# EAGLE board Resistor_Resistor (EAGLE 8.3.0), part 9 of 32
## Placement (x,y rotation side) (continued)
R10473  10K  [0201]  88.75,45.16 0 top
R10474  10K  [0201]  88.75,45.77 0 top
R10475  10K  [0201]  88.75,46.38 0 top
R10476  10K  [0201]  88.75,46.99 0 top
R10477  10K  [0201]  88.75,47.6 0 top
R10478  10K  [0201]  88.75,48.21 0 top
R10479  10K  [0201]  88.75,48.82 0 top
R10480  10K  [0201]  88.75,49.43 0 top
R10481  10K  [0201]  88.75,50.04 0 top
R10482  10K  [0201]  88.75,50.65 0 top
R10483  10K  [0201]  88.75,51.26 0 top
R10484  10K  [0201]  88.75,51.87 0 top
R10485  10K  [0201]  88.75,52.48 0 top
R10486  10K  [0201]  88.75,53.09 0 top
R10487  10K  [0201]  88.75,53.7 0 top
R10488  10K  [0201]  88.75,54.31 0 top
R10489  10K  [0201]  88.75,54.91 0 top
R10490  10K  [0201]  88.75,55.52 0 top
R10491  10K  [0201]  88.75,56.13 0 top
R10492  10K  [0201]  88.75,56.74 0 top
R10493  10K  [0201]  88.75,57.35 0 top
R10494  10K  [0201]  88.75,57.96 0 top
R10495  10K  [0201]  88.75,58.57 0 top
R10496  10K  [0201]  88.75,59.18 0 top
R10497  10K  [0201]  88.75,59.79 0 top
R10498  10K  [0201]  88.75,60.4 0 top
R10499  10K  [0201]  88.75,61.01 0 top
R10500  10K  [0201]  88.75,61.62 0 top
R10501  10K  [0201]  88.75,62.23 0 top
R10502  10K  [0201]  88.75,62.84 0 top
R10503  10K  [0201]  88.75,63.45 0 top
R10504  10K  [0201]  88.75,64.06 0 top
R10505  10K  [0201]  88.75,64.67 0 top
R10506  10K  [0201]  88.75,65.28 0 top
R10507  10K  [0201]  88.75,65.89 0 top
R10508  10K  [0201]  88.75,66.5 0 top
R10509  10K  [0201]  88.75,67.11 0 top
R10510  10K  [0201]  88.75,67.72 0 top
R10511  10K  [0201]  88.75,68.33 0 top
R10512  10K  [0201]  88.75,68.94 0 top
R10513  10K  [0201]  88.75,69.55 0 top
R10514  10K  [0201]  88.75,70.15 0 top
R10515  10K  [0201]  88.75,70.76 0 top
R10516  10K  [0201]  88.75,71.37 0 top
R10517  10K  [0201]  88.75,71.98 0 top
R10518  10K  [0201]  88.75,72.59 0 top
R10519  10K  [0201]  88.75,73.2 0 top
R10520  10K  [0201]  88.75,73.81 0 top
R10521  10K  [0201]  88.75,74.42 0 top
R10522  10K  [0201]  88.75,75.03 0 top
R10523  10K  [0201]  88.75,75.64 0 top
R10524  10K  [0201]  88.75,76.25 0 top
R10525  10K  [0201]  88.75,76.86 0 top
R10526  10K  [0201]  88.75,77.47 0 top
R10527  10K  [0201]  88.75,78.08 0 top
R10528  10K  [0201]  88.75,78.69 0 top
R10529  10K  [0201]  88.75,79.3 0 top
R10530  10K  [0201]  88.75,79.91 0 top
R10531  10K  [0201]  88.75,80.52 0 top
R10532  10K  [0201]  88.75,81.13 0 top
R10533  10K  [0201]  88.75,81.74 0 top
R10534  10K  [0201]  88.75,82.35 0 top
R10535  10K  [0201]  88.75,82.96 0 top
R10536  10K  [0201]  88.75,83.57 0 top
R10537  10K  [0201]  88.75,84.18 0 top
R10538  10K  [0201]  88.75,84.79 0 top
R10539  10K  [0201]  88.75,85.39 0 top
R10540  10K  [0201]  88.75,86 0 top
R10541  10K  [0201]  88.75,86.61 0 top
R10542  10K  [0201]  88.75,87.22 0 top
R10543  10K  [0201]  88.75,87.83 0 top
R10544  10K  [0201]  88.75,88.44 0 top
R10545  10K  [0201]  88.75,89.05 0 top
R10546  10K  [0201]  88.75,89.66 0 top
R10547  10K  [0201]  88.75,90.27 0 top
R10548  10K  [0201]  88.75,90.88 0 top
R10549  10K  [0201]  88.75,91.49 0 top
R10550  10K  [0201]  88.75,92.1 0 top
R10551  10K  [0201]  88.75,92.71 0 top
R10552  10K  [0201]  88.75,93.32 0 top
R10553  10K  [0201]  88.75,93.93 0 top
R10554  10K  [0201]  88.75,94.54 0 top
R10555  10K  [0201]  88.75,95.15 0 top
R10556  10K  [0201]  88.75,95.76 0 top
R10557  10K  [0201]  88.75,96.37 0 top
R10558  10K  [0201]  88.75,96.98 0 top
R10559  10K  [0201]  88.75,97.59 0 top
R10560  10K  [0201]  88.75,98.2 0 top
R10561  10K  [0201]  88.75,98.81 0 top
R10562  10K  [0201]  88.75,99.42 0 top
R10563  10K  [0201]  88.75,100.03 0 top
R10564  10K  [0201]  88.75,100.63 0 top
R10565  10K  [0201]  88.75,101.24 0 top
R10566  10K  [0201]  88.75,101.85 0 top
R10567  10K  [0201]  88.75,102.46 0 top
R10568  10K  [0201]  88.75,103.07 0 top
R10569  10K  [0201]  88.75,103.68 0 top
R10570  10K  [0201]  88.75,104.29 0 top
R10571  10K  [0201]  88.75,104.9 0 top
R10572  10K  [0201]  88.75,105.51 0 top
R10573  10K  [0201]  88.75,106.12 0 top
R10574  10K  [0201]  88.75,106.73 0 top
R10575  10K  [0201]  88.75,107.34 0 top
R10576  10K  [0201]  88.75,107.95 0 top
R10577  10K  [0201]  88.75,108.56 0 top
R10578  10K  [0201]  88.75,109.17 0 top
R10579  10K  [0201]  88.75,109.78 0 top
R10580  10K  [0201]  88.75,110.39 0 top
R10581  10K  [0201]  88.75,111 0 top
R10582  10K  [0201]  88.75,111.61 0 top
R10583  10K  [0201]  88.75,112.22 0 top
R10584  10K  [0201]  88.75,112.83 0 top
R10585  10K  [0201]  88.75,113.44 0 top
R10586  10K  [0201]  88.75,114.05 0 top
R10587  10K  [0201]  88.75,114.66 0 top
R10588  10K  [0201]  88.75,115.27 0 top
R10589  10K  [0201]  88.75,115.87 0 top
R10590  10K  [0201]  88.75,116.48 0 top
R10591  10K  [0201]  88.75,117.09 0 top
R10592  10K  [0201]  88.75,117.7 0 top
R10593  10K  [0201]  88.75,118.31 0 top
R10594  10K  [0201]  88.75,118.92 0 top
R10595  10K  [0201]  88.75,119.53 0 top
R10596  10K  [0201]  88.75,120.14 0 top
R10597  10K  [0201]  88.75,120.75 0 top
R10598  10K  [0201]  88.75,121.36 0 top
R10599  10K  [0201]  88.75,121.97 0 top
R10600  10K  [0201]  88.75,122.58 0 top
R10601  10K  [0201]  89.97,1.27 0 top
R10602  10K  [0201]  89.97,1.88 0 top
R10603  10K  [0201]  89.97,2.49 0 top
R10604  10K  [0201]  89.97,3.1 0 top
R10605  10K  [0201]  89.97,3.71 0 top
R10606  10K  [0201]  89.97,4.32 0 top
R10607  10K  [0201]  89.97,4.93 0 top
R10608  10K  [0201]  89.97,5.54 0 top
R10609  10K  [0201]  89.97,6.15 0 top
R10610  10K  [0201]  89.97,6.76 0 top
R10611  10K  [0201]  89.97,7.37 0 top
R10612  10K  [0201]  89.97,7.98 0 top
R10613  10K  [0201]  89.97,8.59 0 top
R10614  10K  [0201]  89.97,9.19 0 top
R10615  10K  [0201]  89.97,9.8 0 top
R10616  10K  [0201]  89.97,10.41 0 top
R10617  10K  [0201]  89.97,11.02 0 top
R10618  10K  [0201]  89.97,11.63 0 top
R10619  10K  [0201]  89.97,12.24 0 top
R10620  10K  [0201]  89.97,12.85 0 top
R10621  10K  [0201]  89.97,13.46 0 top
R10622  10K  [0201]  89.97,14.07 0 top
R10623  10K  [0201]  89.97,14.68 0 top
R10624  10K  [0201]  89.97,15.29 0 top
R10625  10K  [0201]  89.97,15.9 0 top
R10626  10K  [0201]  89.97,16.51 0 top
R10627  10K  [0201]  89.97,17.12 0 top
R10628  10K  [0201]  89.97,17.73 0 top
R10629  10K  [0201]  89.97,18.34 0 top
R10630  10K  [0201]  89.97,18.95 0 top
R10631  10K  [0201]  89.97,19.56 0 top
R10632  10K  [0201]  89.97,20.17 0 top
R10633  10K  [0201]  89.97,20.78 0 top
R10634  10K  [0201]  89.97,21.39 0 top
R10635  10K  [0201]  89.97,22 0 top
R10636  10K  [0201]  89.97,22.61 0 top
R10637  10K  [0201]  89.97,23.22 0 top
R10638  10K  [0201]  89.97,23.83 0 top
R10639  10K  [0201]  89.97,24.43 0 top
R10640  10K  [0201]  89.97,25.04 0 top
R10641  10K  [0201]  89.97,25.65 0 top
R10642  10K  [0201]  89.97,26.26 0 top
R10643  10K  [0201]  89.97,26.87 0 top
R10644  10K  [0201]  89.97,27.48 0 top
R10645  10K  [0201]  89.97,28.09 0 top
R10646  10K  [0201]  89.97,28.7 0 top
R10647  10K  [0201]  89.97,29.31 0 top
R10648  10K  [0201]  89.97,29.92 0 top
R10649  10K  [0201]  89.97,30.53 0 top
R10650  10K  [0201]  89.97,31.14 0 top
R10651  10K  [0201]  89.97,31.75 0 top
R10652  10K  [0201]  89.97,32.36 0 top
R10653  10K  [0201]  89.97,32.97 0 top
R10654  10K  [0201]  89.97,33.58 0 top
R10655  10K  [0201]  89.97,34.19 0 top
R10656  10K  [0201]  89.97,34.8 0 top
R10657  10K  [0201]  89.97,35.41 0 top
R10658  10K  [0201]  89.97,36.02 0 top
R10659  10K  [0201]  89.97,36.63 0 top
R10660  10K  [0201]  89.97,37.24 0 top
R10661  10K  [0201]  89.97,37.85 0 top
R10662  10K  [0201]  89.97,38.46 0 top
R10663  10K  [0201]  89.97,39.07 0 top
R10664  10K  [0201]  89.97,39.67 0 top
R10665  10K  [0201]  89.97,40.28 0 top
R10666  10K  [0201]  89.97,40.89 0 top
R10667  10K  [0201]  89.97,41.5 0 top
R10668  10K  [0201]  89.97,42.11 0 top
R10669  10K  [0201]  89.97,42.72 0 top
R10670  10K  [0201]  89.97,43.33 0 top
R10671  10K  [0201]  89.97,43.94 0 top
R10672  10K  [0201]  89.97,44.55 0 top
R10673  10K  [0201]  89.97,45.16 0 top
R10674  10K  [0201]  89.97,45.77 0 top
R10675  10K  [0201]  89.97,46.38 0 top
R10676  10K  [0201]  89.97,46.99 0 top
R10677  10K  [0201]  89.97,47.6 0 top
R10678  10K  [0201]  89.97,48.21 0 top
R10679  10K  [0201]  89.97,48.82 0 top
R10680  10K  [0201]  89.97,49.43 0 top
R10681  10K  [0201]  89.97,50.04 0 top
R10682  10K  [0201]  89.97,50.65 0 top
R10683  10K  [0201]  89.97,51.26 0 top
R10684  10K  [0201]  89.97,51.87 0 top
R10685  10K  [0201]  89.97,52.48 0 top
R10686  10K  [0201]  89.97,53.09 0 top
R10687  10K  [0201]  89.97,53.7 0 top
R10688  10K  [0201]  89.97,54.31 0 top
R10689  10K  [0201]  89.97,54.91 0 top
R10690  10K  [0201]  89.97,55.52 0 top
R10691  10K  [0201]  89.97,56.13 0 top
R10692  10K  [0201]  89.97,56.74 0 top
R10693  10K  [0201]  89.97,57.35 0 top
R10694  10K  [0201]  89.97,57.96 0 top
R10695  10K  [0201]  89.97,58.57 0 top
R10696  10K  [0201]  89.97,59.18 0 top
R10697  10K  [0201]  89.97,59.79 0 top
R10698  10K  [0201]  89.97,60.4 0 top
R10699  10K  [0201]  89.97,61.01 0 top
R10700  10K  [0201]  89.97,61.62 0 top
R10701  10K  [0201]  89.97,62.23 0 top
R10702  10K  [0201]  89.97,62.84 0 top
R10703  10K  [0201]  89.97,63.45 0 top
R10704  10K  [0201]  89.97,64.06 0 top
R10705  10K  [0201]  89.97,64.67 0 top
R10706  10K  [0201]  89.97,65.28 0 top
R10707  10K  [0201]  89.97,65.89 0 top
R10708  10K  [0201]  89.97,66.5 0 top
R10709  10K  [0201]  89.97,67.11 0 top
R10710  10K  [0201]  89.97,67.72 0 top
R10711  10K  [0201]  89.97,68.33 0 top
R10712  10K  [0201]  89.97,68.94 0 top
R10713  10K  [0201]  89.97,69.55 0 top
R10714  10K  [0201]  89.97,70.15 0 top
R10715  10K  [0201]  89.97,70.76 0 top
R10716  10K  [0201]  89.97,71.37 0 top
R10717  10K  [0201]  89.97,71.98 0 top
R10718  10K  [0201]  89.97,72.59 0 top
R10719  10K  [0201]  89.97,73.2 0 top
R10720  10K  [0201]  89.97,73.81 0 top
R10721  10K  [0201]  89.97,74.42 0 top
R10722  10K  [0201]  89.97,75.03 0 top
R10723  10K  [0201]  89.97,75.64 0 top
R10724  10K  [0201]  89.97,76.25 0 top
R10725  10K  [0201]  89.97,76.86 0 top
R10726  10K  [0201]  89.97,77.47 0 top
R10727  10K  [0201]  89.97,78.08 0 top
R10728  10K  [0201]  89.97,78.69 0 top
R10729  10K  [0201]  89.97,79.3 0 top
R10730  10K  [0201]  89.97,79.91 0 top
R10731  10K  [0201]  89.97,80.52 0 top
R10732  10K  [0201]  89.97,81.13 0 top
R10733  10K  [0201]  89.97,81.74 0 top
R10734  10K  [0201]  89.97,82.35 0 top
R10735  10K  [0201]  89.97,82.96 0 top
R10736  10K  [0201]  89.97,83.57 0 top
R10737  10K  [0201]  89.97,84.18 0 top
R10738  10K  [0201]  89.97,84.79 0 top
R10739  10K  [0201]  89.97,85.39 0 top
R10740  10K  [0201]  89.97,86 0 top
R10741  10K  [0201]  89.97,86.61 0 top
R10742  10K  [0201]  89.97,87.22 0 top
R10743  10K  [0201]  89.97,87.83 0 top
R10744  10K  [0201]  89.97,88.44 0 top
R10745  10K  [0201]  89.97,89.05 0 top
R10746  10K  [0201]  89.97,89.66 0 top
R10747  10K  [0201]  89.97,90.27 0 top
R10748  10K  [0201]  89.97,90.88 0 top
R10749  10K  [0201]  89.97,91.49 0 top
R10750  10K  [0201]  89.97,92.1 0 top
R10751  10K  [0201]  89.97,92.71 0 top
R10752  10K  [0201]  89.97,93.32 0 top
R10753  10K  [0201]  89.97,93.93 0 top
R10754  10K  [0201]  89.97,94.54 0 top
R10755  10K  [0201]  89.97,95.15 0 top
R10756  10K  [0201]  89.97,95.76 0 top
R10757  10K  [0201]  89.97,96.37 0 top
R10758  10K  [0201]  89.97,96.98 0 top
R10759  10K  [0201]  89.97,97.59 0 top
R10760  10K  [0201]  89.97,98.2 0 top
R10761  10K  [0201]  89.97,98.81 0 top
R10762  10K  [0201]  89.97,99.42 0 top
R10763  10K  [0201]  89.97,100.03 0 top
R10764  10K  [0201]  89.97,100.63 0 top
R10765  10K  [0201]  89.97,101.24 0 top
R10766  10K  [0201]  89.97,101.85 0 top
R10767  10K  [0201]  89.97,102.46 0 top
R10768  10K  [0201]  89.97,103.07 0 top
R10769  10K  [0201]  89.97,103.68 0 top
R10770  10K  [0201]  89.97,104.29 0 top
R10771  10K  [0201]  89.97,104.9 0 top
R10772  10K  [0201]  89.97,105.51 0 top
R10773  10K  [0201]  89.97,106.12 0 top
R10774  10K  [0201]  89.97,106.73 0 top
R10775  10K  [0201]  89.97,107.34 0 top
R10776  10K  [0201]  89.97,107.95 0 top
R10777  10K  [0201]  89.97,108.56 0 top
R10778  10K  [0201]  89.97,109.17 0 top
R10779  10K  [0201]  89.97,109.78 0 top
R10780  10K  [0201]  89.97,110.39 0 top
R10781  10K  [0201]  89.97,111 0 top
R10782  10K  [0201]  89.97,111.61 0 top
R10783  10K  [0201]  89.97,112.22 0 top
R10784  10K  [0201]  89.97,112.83 0 top
R10785  10K  [0201]  89.97,113.44 0 top
R10786  10K  [0201]  89.97,114.05 0 top
R10787  10K  [0201]  89.97,114.66 0 top
R10788  10K  [0201]  89.97,115.27 0 top
R10789  10K  [0201]  89.97,115.87 0 top
R10790  10K  [0201]  89.97,116.48 0 top
R10791  10K  [0201]  89.97,117.09 0 top
R10792  10K  [0201]  89.97,117.7 0 top
R10793  10K  [0201]  89.97,118.31 0 top
R10794  10K  [0201]  89.97,118.92 0 top
R10795  10K  [0201]  89.97,119.53 0 top
R10796  10K  [0201]  89.97,120.14 0 top
R10797  10K  [0201]  89.97,120.75 0 top
R10798  10K  [0201]  89.97,121.36 0 top
R10799  10K  [0201]  89.97,121.97 0 top
R10800  10K  [0201]  89.97,122.58 0 top
R10801  10K  [0201]  91.19,1.27 0 top
R10802  10K  [0201]  91.19,1.88 0 top
R10803  10K  [0201]  91.19,2.49 0 top
R10804  10K  [0201]  91.19,3.1 0 top
R10805  10K  [0201]  91.19,3.71 0 top
R10806  10K  [0201]  91.19,4.32 0 top
R10807  10K  [0201]  91.19,4.93 0 top
R10808  10K  [0201]  91.19,5.54 0 top
R10809  10K  [0201]  91.19,6.15 0 top
R10810  10K  [0201]  91.19,6.76 0 top
R10811  10K  [0201]  91.19,7.37 0 top
R10812  10K  [0201]  91.19,7.98 0 top
R10813  10K  [0201]  91.19,8.59 0 top
R10814  10K  [0201]  91.19,9.19 0 top
R10815  10K  [0201]  91.19,9.8 0 top
R10816  10K  [0201]  91.19,10.41 0 top
R10817  10K  [0201]  91.19,11.02 0 top
R10818  10K  [0201]  91.19,11.63 0 top
R10819  10K  [0201]  91.19,12.24 0 top
R10820  10K  [0201]  91.19,12.85 0 top
R10821  10K  [0201]  91.19,13.46 0 top
R10822  10K  [0201]  91.19,14.07 0 top
R10823  10K  [0201]  91.19,14.68 0 top
R10824  10K  [0201]  91.19,15.29 0 top
R10825  10K  [0201]  91.19,15.9 0 top
R10826  10K  [0201]  91.19,16.51 0 top
R10827  10K  [0201]  91.19,17.12 0 top
R10828  10K  [0201]  91.19,17.73 0 top
R10829  10K  [0201]  91.19,18.34 0 top
R10830  10K  [0201]  91.19,18.95 0 top
R10831  10K  [0201]  91.19,19.56 0 top
R10832  10K  [0201]  91.19,20.17 0 top
R10833  10K  [0201]  91.19,20.78 0 top
R10834  10K  [0201]  91.19,21.39 0 top
R10835  10K  [0201]  91.19,22 0 top
R10836  10K  [0201]  91.19,22.61 0 top
R10837  10K  [0201]  91.19,23.22 0 top
R10838  10K  [0201]  91.19,23.83 0 top
R10839  10K  [0201]  91.19,24.43 0 top
R10840  10K  [0201]  91.19,25.04 0 top
R10841  10K  [0201]  91.19,25.65 0 top
R10842  10K  [0201]  91.19,26.26 0 top
R10843  10K  [0201]  91.19,26.87 0 top
R10844  10K  [0201]  91.19,27.48 0 top
R10845  10K  [0201]  91.19,28.09 0 top
R10846  10K  [0201]  91.19,28.7 0 top
R10847  10K  [0201]  91.19,29.31 0 top
R10848  10K  [0201]  91.19,29.92 0 top
R10849  10K  [0201]  91.19,30.53 0 top
R10850  10K  [0201]  91.19,31.14 0 top
R10851  10K  [0201]  91.19,31.75 0 top
R10852  10K  [0201]  91.19,32.36 0 top
R10853  10K  [0201]  91.19,32.97 0 top
R10854  10K  [0201]  91.19,33.58 0 top
R10855  10K  [0201]  91.19,34.19 0 top
R10856  10K  [0201]  91.19,34.8 0 top
R10857  10K  [0201]  91.19,35.41 0 top
R10858  10K  [0201]  91.19,36.02 0 top
R10859  10K  [0201]  91.19,36.63 0 top
R10860  10K  [0201]  91.19,37.24 0 top
R10861  10K  [0201]  91.19,37.85 0 top
R10862  10K  [0201]  91.19,38.46 0 top
R10863  10K  [0201]  91.19,39.07 0 top
R10864  10K  [0201]  91.19,39.67 0 top
R10865  10K  [0201]  91.19,40.28 0 top
R10866  10K  [0201]  91.19,40.89 0 top
R10867  10K  [0201]  91.19,41.5 0 top
R10868  10K  [0201]  91.19,42.11 0 top
R10869  10K  [0201]  91.19,42.72 0 top
R10870  10K  [0201]  91.19,43.33 0 top
R10871  10K  [0201]  91.19,43.94 0 top
R10872  10K  [0201]  91.19,44.55 0 top
R10873  10K  [0201]  91.19,45.16 0 top
R10874  10K  [0201]  91.19,45.77 0 top
R10875  10K  [0201]  91.19,46.38 0 top
R10876  10K  [0201]  91.19,46.99 0 top
R10877  10K  [0201]  91.19,47.6 0 top
R10878  10K  [0201]  91.19,48.21 0 top
R10879  10K  [0201]  91.19,48.82 0 top
R10880  10K  [0201]  91.19,49.43 0 top
R10881  10K  [0201]  91.19,50.04 0 top
R10882  10K  [0201]  91.19,50.65 0 top
R10883  10K  [0201]  91.19,51.26 0 top
R10884  10K  [0201]  91.19,51.87 0 top
R10885  10K  [0201]  91.19,52.48 0 top
R10886  10K  [0201]  91.19,53.09 0 top
R10887  10K  [0201]  91.19,53.7 0 top
R10888  10K  [0201]  91.19,54.31 0 top
R10889  10K  [0201]  91.19,54.91 0 top
R10890  10K  [0201]  91.19,55.52 0 top
R10891  10K  [0201]  91.19,56.13 0 top
R10892  10K  [0201]  91.19,56.74 0 top
R10893  10K  [0201]  91.19,57.35 0 top
R10894  10K  [0201]  91.19,57.96 0 top
R10895  10K  [0201]  91.19,58.57 0 top
R10896  10K  [0201]  91.19,59.18 0 top
R10897  10K  [0201]  91.19,59.79 0 top
R10898  10K  [0201]  91.19,60.4 0 top
R10899  10K  [0201]  91.19,61.01 0 top
R10900  10K  [0201]  91.19,61.62 0 top
R10901  10K  [0201]  91.19,62.23 0 top
R10902  10K  [0201]  91.19,62.84 0 top
R10903  10K  [0201]  91.19,63.45 0 top
R10904  10K  [0201]  91.19,64.06 0 top
R10905  10K  [0201]  91.19,64.67 0 top
R10906  10K  [0201]  91.19,65.28 0 top
R10907  10K  [0201]  91.19,65.89 0 top
R10908  10K  [0201]  91.19,66.5 0 top
R10909  10K  [0201]  91.19,67.11 0 top
R10910  10K  [0201]  91.19,67.72 0 top
R10911  10K  [0201]  91.19,68.33 0 top
R10912  10K  [0201]  91.19,68.94 0 top
R10913  10K  [0201]  91.19,69.55 0 top
R10914  10K  [0201]  91.19,70.15 0 top
R10915  10K  [0201]  91.19,70.76 0 top
R10916  10K  [0201]  91.19,71.37 0 top
R10917  10K  [0201]  91.19,71.98 0 top
R10918  10K  [0201]  91.19,72.59 0 top
R10919  10K  [0201]  91.19,73.2 0 top
R10920  10K  [0201]  91.19,73.81 0 top
R10921  10K  [0201]  91.19,74.42 0 top
R10922  10K  [0201]  91.19,75.03 0 top
R10923  10K  [0201]  91.19,75.64 0 top
R10924  10K  [0201]  91.19,76.25 0 top
R10925  10K  [0201]  91.19,76.86 0 top
R10926  10K  [0201]  91.19,77.47 0 top
R10927  10K  [0201]  91.19,78.08 0 top
R10928  10K  [0201]  91.19,78.69 0 top
R10929  10K  [0201]  91.19,79.3 0 top
R10930  10K  [0201]  91.19,79.91 0 top
R10931  10K  [0201]  91.19,80.52 0 top
R10932  10K  [0201]  91.19,81.13 0 top
R10933  10K  [0201]  91.19,81.74 0 top
R10934  10K  [0201]  91.19,82.35 0 top
R10935  10K  [0201]  91.19,82.96 0 top
R10936  10K  [0201]  91.19,83.57 0 top
R10937  10K  [0201]  91.19,84.18 0 top
R10938  10K  [0201]  91.19,84.79 0 top
R10939  10K  [0201]  91.19,85.39 0 top
R10940  10K  [0201]  91.19,86 0 top
R10941  10K  [0201]  91.19,86.61 0 top
R10942  10K  [0201]  91.19,87.22 0 top
R10943  10K  [0201]  91.19,87.83 0 top
R10944  10K  [0201]  91.19,88.44 0 top
R10945  10K  [0201]  91.19,89.05 0 top
R10946  10K  [0201]  91.19,89.66 0 top
R10947  10K  [0201]  91.19,90.27 0 top
R10948  10K  [0201]  91.19,90.88 0 top
R10949  10K  [0201]  91.19,91.49 0 top
R10950  10K  [0201]  91.19,92.1 0 top
R10951  10K  [0201]  91.19,92.71 0 top
R10952  10K  [0201]  91.19,93.32 0 top
R10953  10K  [0201]  91.19,93.93 0 top
R10954  10K  [0201]  91.19,94.54 0 top
R10955  10K  [0201]  91.19,95.15 0 top
R10956  10K  [0201]  91.19,95.76 0 top
R10957  10K  [0201]  91.19,96.37 0 top
R10958  10K  [0201]  91.19,96.98 0 top
R10959  10K  [0201]  91.19,97.59 0 top
R10960  10K  [0201]  91.19,98.2 0 top
R10961  10K  [0201]  91.19,98.81 0 top
R10962  10K  [0201]  91.19,99.42 0 top
R10963  10K  [0201]  91.19,100.03 0 top
R10964  10K  [0201]  91.19,100.63 0 top
R10965  10K  [0201]  91.19,101.24 0 top
R10966  10K  [0201]  91.19,101.85 0 top
R10967  10K  [0201]  91.19,102.46 0 top
R10968  10K  [0201]  91.19,103.07 0 top
R10969  10K  [0201]  91.19,103.68 0 top
R10970  10K  [0201]  91.19,104.29 0 top
R10971  10K  [0201]  91.19,104.9 0 top
R10972  10K  [0201]  91.19,105.51 0 top
R10973  10K  [0201]  91.19,106.12 0 top
R10974  10K  [0201]  91.19,106.73 0 top
R10975  10K  [0201]  91.19,107.34 0 top
R10976  10K  [0201]  91.19,107.95 0 top
R10977  10K  [0201]  91.19,108.56 0 top
R10978  10K  [0201]  91.19,109.17 0 top
R10979  10K  [0201]  91.19,109.78 0 top
R10980  10K  [0201]  91.19,110.39 0 top
R10981  10K  [0201]  91.19,111 0 top
R10982  10K  [0201]  91.19,111.61 0 top
R10983  10K  [0201]  91.19,112.22 0 top
R10984  10K  [0201]  91.19,112.83 0 top
R10985  10K  [0201]  91.19,113.44 0 top
R10986  10K  [0201]  91.19,114.05 0 top
R10987  10K  [0201]  91.19,114.66 0 top
R10988  10K  [0201]  91.19,115.27 0 top
R10989  10K  [0201]  91.19,115.87 0 top
R10990  10K  [0201]  91.19,116.48 0 top
R10991  10K  [0201]  91.19,117.09 0 top
R10992  10K  [0201]  91.19,117.7 0 top
R10993  10K  [0201]  91.19,118.31 0 top
R10994  10K  [0201]  91.19,118.92 0 top
R10995  10K  [0201]  91.19,119.53 0 top
R10996  10K  [0201]  91.19,120.14 0 top
R10997  10K  [0201]  91.19,120.75 0 top
R10998  10K  [0201]  91.19,121.36 0 top
R10999  10K  [0201]  91.19,121.97 0 top
R11000  10K  [0201]  91.19,122.58 0 top
R11001  10K  [0201]  92.41,1.27 0 top
R11002  10K  [0201]  92.41,1.88 0 top
R11003  10K  [0201]  92.41,2.49 0 top
R11004  10K  [0201]  92.41,3.1 0 top
R11005  10K  [0201]  92.41,3.71 0 top
R11006  10K  [0201]  92.41,4.32 0 top
R11007  10K  [0201]  92.41,4.93 0 top
R11008  10K  [0201]  92.41,5.54 0 top
R11009  10K  [0201]  92.41,6.15 0 top
R11010  10K  [0201]  92.41,6.76 0 top
R11011  10K  [0201]  92.41,7.37 0 top
R11012  10K  [0201]  92.41,7.98 0 top
R11013  10K  [0201]  92.41,8.59 0 top
R11014  10K  [0201]  92.41,9.19 0 top
R11015  10K  [0201]  92.41,9.8 0 top
R11016  10K  [0201]  92.41,10.41 0 top
R11017  10K  [0201]  92.41,11.02 0 top
R11018  10K  [0201]  92.41,11.63 0 top
R11019  10K  [0201]  92.41,12.24 0 top
R11020  10K  [0201]  92.41,12.85 0 top
R11021  10K  [0201]  92.41,13.46 0 top
R11022  10K  [0201]  92.41,14.07 0 top
R11023  10K  [0201]  92.41,14.68 0 top
R11024  10K  [0201]  92.41,15.29 0 top
R11025  10K  [0201]  92.41,15.9 0 top
R11026  10K  [0201]  92.41,16.51 0 top
R11027  10K  [0201]  92.41,17.12 0 top
R11028  10K  [0201]  92.41,17.73 0 top
R11029  10K  [0201]  92.41,18.34 0 top
R11030  10K  [0201]  92.41,18.95 0 top
R11031  10K  [0201]  92.41,19.56 0 top
R11032  10K  [0201]  92.41,20.17 0 top
R11033  10K  [0201]  92.41,20.78 0 top
R11034  10K  [0201]  92.41,21.39 0 top
R11035  10K  [0201]  92.41,22 0 top
R11036  10K  [0201]  92.41,22.61 0 top
R11037  10K  [0201]  92.41,23.22 0 top
R11038  10K  [0201]  92.41,23.83 0 top
R11039  10K  [0201]  92.41,24.43 0 top
R11040  10K  [0201]  92.41,25.04 0 top
R11041  10K  [0201]  92.41,25.65 0 top
R11042  10K  [0201]  92.41,26.26 0 top
R11043  10K  [0201]  92.41,26.87 0 top
R11044  10K  [0201]  92.41,27.48 0 top
R11045  10K  [0201]  92.41,28.09 0 top
R11046  10K  [0201]  92.41,28.7 0 top
R11047  10K  [0201]  92.41,29.31 0 top
R11048  10K  [0201]  92.41,29.92 0 top
R11049  10K  [0201]  92.41,30.53 0 top
R11050  10K  [0201]  92.41,31.14 0 top
R11051  10K  [0201]  92.41,31.75 0 top
R11052  10K  [0201]  92.41,32.36 0 top
R11053  10K  [0201]  92.41,32.97 0 top
R11054  10K  [0201]  92.41,33.58 0 top
R11055  10K  [0201]  92.41,34.19 0 top
R11056  10K  [0201]  92.41,34.8 0 top
R11057  10K  [0201]  92.41,35.41 0 top
R11058  10K  [0201]  92.41,36.02 0 top
R11059  10K  [0201]  92.41,36.63 0 top
R11060  10K  [0201]  92.41,37.24 0 top
R11061  10K  [0201]  92.41,37.85 0 top
R11062  10K  [0201]  92.41,38.46 0 top
R11063  10K  [0201]  92.41,39.07 0 top
R11064  10K  [0201]  92.41,39.67 0 top
R11065  10K  [0201]  92.41,40.28 0 top
R11066  10K  [0201]  92.41,40.89 0 top
R11067  10K  [0201]  92.41,41.5 0 top
R11068  10K  [0201]  92.41,42.11 0 top
R11069  10K  [0201]  92.41,42.72 0 top
R11070  10K  [0201]  92.41,43.33 0 top
R11071  10K  [0201]  92.41,43.94 0 top
R11072  10K  [0201]  92.41,44.55 0 top
R11073  10K  [0201]  92.41,45.16 0 top
R11074  10K  [0201]  92.41,45.77 0 top
R11075  10K  [0201]  92.41,46.38 0 top
R11076  10K  [0201]  92.41,46.99 0 top
R11077  10K  [0201]  92.41,47.6 0 top
R11078  10K  [0201]  92.41,48.21 0 top
R11079  10K  [0201]  92.41,48.82 0 top
R11080  10K  [0201]  92.41,49.43 0 top
R11081  10K  [0201]  92.41,50.04 0 top
R11082  10K  [0201]  92.41,50.65 0 top
R11083  10K  [0201]  92.41,51.26 0 top
R11084  10K  [0201]  92.41,51.87 0 top
R11085  10K  [0201]  92.41,52.48 0 top
R11086  10K  [0201]  92.41,53.09 0 top
R11087  10K  [0201]  92.41,53.7 0 top
R11088  10K  [0201]  92.41,54.31 0 top
R11089  10K  [0201]  92.41,54.91 0 top
R11090  10K  [0201]  92.41,55.52 0 top
R11091  10K  [0201]  92.41,56.13 0 top
R11092  10K  [0201]  92.41,56.74 0 top
R11093  10K  [0201]  92.41,57.35 0 top
R11094  10K  [0201]  92.41,57.96 0 top
R11095  10K  [0201]  92.41,58.57 0 top
R11096  10K  [0201]  92.41,59.18 0 top
R11097  10K  [0201]  92.41,59.79 0 top
R11098  10K  [0201]  92.41,60.4 0 top
R11099  10K  [0201]  92.41,61.01 0 top
R11100  10K  [0201]  92.41,61.62 0 top
R11101  10K  [0201]  92.41,62.23 0 top
R11102  10K  [0201]  92.41,62.84 0 top
R11103  10K  [0201]  92.41,63.45 0 top
R11104  10K  [0201]  92.41,64.06 0 top
R11105  10K  [0201]  92.41,64.67 0 top
R11106  10K  [0201]  92.41,65.28 0 top
R11107  10K  [0201]  92.41,65.89 0 top
R11108  10K  [0201]  92.41,66.5 0 top
R11109  10K  [0201]  92.41,67.11 0 top
R11110  10K  [0201]  92.41,67.72 0 top
R11111  10K  [0201]  92.41,68.33 0 top
R11112  10K  [0201]  92.41,68.94 0 top
R11113  10K  [0201]  92.41,69.55 0 top
R11114  10K  [0201]  92.41,70.15 0 top
R11115  10K  [0201]  92.41,70.76 0 top
R11116  10K  [0201]  92.41,71.37 0 top
R11117  10K  [0201]  92.41,71.98 0 top
R11118  10K  [0201]  92.41,72.59 0 top
R11119  10K  [0201]  92.41,73.2 0 top
R11120  10K  [0201]  92.41,73.81 0 top
R11121  10K  [0201]  92.41,74.42 0 top
R11122  10K  [0201]  92.41,75.03 0 top
R11123  10K  [0201]  92.41,75.64 0 top
R11124  10K  [0201]  92.41,76.25 0 top
R11125  10K  [0201]  92.41,76.86 0 top
R11126  10K  [0201]  92.41,77.47 0 top
R11127  10K  [0201]  92.41,78.08 0 top
R11128  10K  [0201]  92.41,78.69 0 top
R11129  10K  [0201]  92.41,79.3 0 top
R11130  10K  [0201]  92.41,79.91 0 top
R11131  10K  [0201]  92.41,80.52 0 top
R11132  10K  [0201]  92.41,81.13 0 top
R11133  10K  [0201]  92.41,81.74 0 top
R11134  10K  [0201]  92.41,82.35 0 top
R11135  10K  [0201]  92.41,82.96 0 top
R11136  10K  [0201]  92.41,83.57 0 top
R11137  10K  [0201]  92.41,84.18 0 top
R11138  10K  [0201]  92.41,84.79 0 top
R11139  10K  [0201]  92.41,85.39 0 top
R11140  10K  [0201]  92.41,86 0 top
R11141  10K  [0201]  92.41,86.61 0 top
R11142  10K  [0201]  92.41,87.22 0 top
R11143  10K  [0201]  92.41,87.83 0 top
R11144  10K  [0201]  92.41,88.44 0 top
R11145  10K  [0201]  92.41,89.05 0 top
R11146  10K  [0201]  92.41,89.66 0 top
R11147  10K  [0201]  92.41,90.27 0 top
R11148  10K  [0201]  92.41,90.88 0 top
R11149  10K  [0201]  92.41,91.49 0 top
R11150  10K  [0201]  92.41,92.1 0 top
R11151  10K  [0201]  92.41,92.71 0 top
R11152  10K  [0201]  92.41,93.32 0 top
R11153  10K  [0201]  92.41,93.93 0 top
R11154  10K  [0201]  92.41,94.54 0 top
R11155  10K  [0201]  92.41,95.15 0 top
R11156  10K  [0201]  92.41,95.76 0 top
R11157  10K  [0201]  92.41,96.37 0 top
R11158  10K  [0201]  92.41,96.98 0 top
R11159  10K  [0201]  92.41,97.59 0 top
R11160  10K  [0201]  92.41,98.2 0 top
R11161  10K  [0201]  92.41,98.81 0 top
R11162  10K  [0201]  92.41,99.42 0 top
R11163  10K  [0201]  92.41,100.03 0 top
R11164  10K  [0201]  92.41,100.63 0 top
R11165  10K  [0201]  92.41,101.24 0 top
R11166  10K  [0201]  92.41,101.85 0 top
R11167  10K  [0201]  92.41,102.46 0 top
R11168  10K  [0201]  92.41,103.07 0 top
R11169  10K  [0201]  92.41,103.68 0 top
R11170  10K  [0201]  92.41,104.29 0 top
R11171  10K  [0201]  92.41,104.9 0 top
R11172  10K  [0201]  92.41,105.51 0 top
R11173  10K  [0201]  92.41,106.12 0 top
R11174  10K  [0201]  92.41,106.73 0 top
R11175  10K  [0201]  92.41,107.34 0 top
R11176  10K  [0201]  92.41,107.95 0 top
R11177  10K  [0201]  92.41,108.56 0 top
R11178  10K  [0201]  92.41,109.17 0 top
R11179  10K  [0201]  92.41,109.78 0 top
R11180  10K  [0201]  92.41,110.39 0 top
R11181  10K  [0201]  92.41,111 0 top
R11182  10K  [0201]  92.41,111.61 0 top
R11183  10K  [0201]  92.41,112.22 0 top
R11184  10K  [0201]  92.41,112.83 0 top
R11185  10K  [0201]  92.41,113.44 0 top
R11186  10K  [0201]  92.41,114.05 0 top
R11187  10K  [0201]  92.41,114.66 0 top
R11188  10K  [0201]  92.41,115.27 0 top
R11189  10K  [0201]  92.41,115.87 0 top
R11190  10K  [0201]  92.41,116.48 0 top
R11191  10K  [0201]  92.41,117.09 0 top
R11192  10K  [0201]  92.41,117.7 0 top
R11193  10K  [0201]  92.41,118.31 0 top
R11194  10K  [0201]  92.41,118.92 0 top
R11195  10K  [0201]  92.41,119.53 0 top
R11196  10K  [0201]  92.41,120.14 0 top
R11197  10K  [0201]  92.41,120.75 0 top
R11198  10K  [0201]  92.41,121.36 0 top
R11199  10K  [0201]  92.41,121.97 0 top
R11200  10K  [0201]  92.41,122.58 0 top
R11201  10K  [0201]  93.62,1.27 0 top
R11202  10K  [0201]  93.62,1.88 0 top
R11203  10K  [0201]  93.62,2.49 0 top
R11204  10K  [0201]  93.62,3.1 0 top
R11205  10K  [0201]  93.62,3.71 0 top
R11206  10K  [0201]  93.62,4.32 0 top
R11207  10K  [0201]  93.62,4.93 0 top
R11208  10K  [0201]  93.62,5.54 0 top
R11209  10K  [0201]  93.62,6.15 0 top
R11210  10K  [0201]  93.62,6.76 0 top
R11211  10K  [0201]  93.62,7.37 0 top
R11212  10K  [0201]  93.62,7.98 0 top
R11213  10K  [0201]  93.62,8.59 0 top
R11214  10K  [0201]  93.62,9.19 0 top
R11215  10K  [0201]  93.62,9.8 0 top
R11216  10K  [0201]  93.62,10.41 0 top
R11217  10K  [0201]  93.62,11.02 0 top
R11218  10K  [0201]  93.62,11.63 0 top
R11219  10K  [0201]  93.62,12.24 0 top
R11220  10K  [0201]  93.62,12.85 0 top
R11221  10K  [0201]  93.62,13.46 0 top
R11222  10K  [0201]  93.62,14.07 0 top
R11223  10K  [0201]  93.62,14.68 0 top
R11224  10K  [0201]  93.62,15.29 0 top
R11225  10K  [0201]  93.62,15.9 0 top
R11226  10K  [0201]  93.62,16.51 0 top
R11227  10K  [0201]  93.62,17.12 0 top
R11228  10K  [0201]  93.62,17.73 0 top
R11229  10K  [0201]  93.62,18.34 0 top
R11230  10K  [0201]  93.62,18.95 0 top
R11231  10K  [0201]  93.62,19.56 0 top
R11232  10K  [0201]  93.62,20.17 0 top
R11233  10K  [0201]  93.62,20.78 0 top
R11234  10K  [0201]  93.62,21.39 0 top
R11235  10K  [0201]  93.62,22 0 top
R11236  10K  [0201]  93.62,22.61 0 top
R11237  10K  [0201]  93.62,23.22 0 top
R11238  10K  [0201]  93.62,23.83 0 top
R11239  10K  [0201]  93.62,24.43 0 top
R11240  10K  [0201]  93.62,25.04 0 top
R11241  10K  [0201]  93.62,25.65 0 top
R11242  10K  [0201]  93.62,26.26 0 top
R11243  10K  [0201]  93.62,26.87 0 top
R11244  10K  [0201]  93.62,27.48 0 top
R11245  10K  [0201]  93.62,28.09 0 top
R11246  10K  [0201]  93.62,28.7 0 top
R11247  10K  [0201]  93.62,29.31 0 top
R11248  10K  [0201]  93.62,29.92 0 top
R11249  10K  [0201]  93.62,30.53 0 top
R11250  10K  [0201]  93.62,31.14 0 top
R11251  10K  [0201]  93.62,31.75 0 top
R11252  10K  [0201]  93.62,32.36 0 top
R11253  10K  [0201]  93.62,32.97 0 top
R11254  10K  [0201]  93.62,33.58 0 top
R11255  10K  [0201]  93.62,34.19 0 top
R11256  10K  [0201]  93.62,34.8 0 top
R11257  10K  [0201]  93.62,35.41 0 top
R11258  10K  [0201]  93.62,36.02 0 top
R11259  10K  [0201]  93.62,36.63 0 top
R11260  10K  [0201]  93.62,37.24 0 top
R11261  10K  [0201]  93.62,37.85 0 top
R11262  10K  [0201]  93.62,38.46 0 top
R11263  10K  [0201]  93.62,39.07 0 top
R11264  10K  [0201]  93.62,39.67 0 top
R11265  10K  [0201]  93.62,40.28 0 top
R11266  10K  [0201]  93.62,40.89 0 top
R11267  10K  [0201]  93.62,41.5 0 top
R11268  10K  [0201]  93.62,42.11 0 top
R11269  10K  [0201]  93.62,42.72 0 top
R11270  10K  [0201]  93.62,43.33 0 top
R11271  10K  [0201]  93.62,43.94 0 top
R11272  10K  [0201]  93.62,44.55 0 top
R11273  10K  [0201]  93.62,45.16 0 top
R11274  10K  [0201]  93.62,45.77 0 top
R11275  10K  [0201]  93.62,46.38 0 top
R11276  10K  [0201]  93.62,46.99 0 top
R11277  10K  [0201]  93.62,47.6 0 top
R11278  10K  [0201]  93.62,48.21 0 top
R11279  10K  [0201]  93.62,48.82 0 top
R11280  10K  [0201]  93.62,49.43 0 top
R11281  10K  [0201]  93.62,50.04 0 top
R11282  10K  [0201]  93.62,50.65 0 top
R11283  10K  [0201]  93.62,51.26 0 top
R11284  10K  [0201]  93.62,51.87 0 top
R11285  10K  [0201]  93.62,52.48 0 top
R11286  10K  [0201]  93.62,53.09 0 top
R11287  10K  [0201]  93.62,53.7 0 top
R11288  10K  [0201]  93.62,54.31 0 top
R11289  10K  [0201]  93.62,54.91 0 top
R11290  10K  [0201]  93.62,55.52 0 top
R11291  10K  [0201]  93.62,56.13 0 top
R11292  10K  [0201]  93.62,56.74 0 top
R11293  10K  [0201]  93.62,57.35 0 top
R11294  10K  [0201]  93.62,57.96 0 top
R11295  10K  [0201]  93.62,58.57 0 top
R11296  10K  [0201]  93.62,59.18 0 top
R11297  10K  [0201]  93.62,59.79 0 top
R11298  10K  [0201]  93.62,60.4 0 top
R11299  10K  [0201]  93.62,61.01 0 top
R11300  10K  [0201]  93.62,61.62 0 top
R11301  10K  [0201]  93.62,62.23 0 top
R11302  10K  [0201]  93.62,62.84 0 top
R11303  10K  [0201]  93.62,63.45 0 top
R11304  10K  [0201]  93.62,64.06 0 top
R11305  10K  [0201]  93.62,64.67 0 top
R11306  10K  [0201]  93.62,65.28 0 top
R11307  10K  [0201]  93.62,65.89 0 top
R11308  10K  [0201]  93.62,66.5 0 top
R11309  10K  [0201]  93.62,67.11 0 top
R11310  10K  [0201]  93.62,67.72 0 top
R11311  10K  [0201]  93.62,68.33 0 top
R11312  10K  [0201]  93.62,68.94 0 top
R11313  10K  [0201]  93.62,69.55 0 top
R11314  10K  [0201]  93.62,70.15 0 top
R11315  10K  [0201]  93.62,70.76 0 top
R11316  10K  [0201]  93.62,71.37 0 top
R11317  10K  [0201]  93.62,71.98 0 top
R11318  10K  [0201]  93.62,72.59 0 top
R11319  10K  [0201]  93.62,73.2 0 top
R11320  10K  [0201]  93.62,73.81 0 top
R11321  10K  [0201]  93.62,74.42 0 top
R11322  10K  [0201]  93.62,75.03 0 top
R11323  10K  [0201]  93.62,75.64 0 top
R11324  10K  [0201]  93.62,76.25 0 top
R11325  10K  [0201]  93.62,76.86 0 top
R11326  10K  [0201]  93.62,77.47 0 top
R11327  10K  [0201]  93.62,78.08 0 top
R11328  10K  [0201]  93.62,78.69 0 top
R11329  10K  [0201]  93.62,79.3 0 top
R11330  10K  [0201]  93.62,79.91 0 top
R11331  10K  [0201]  93.62,80.52 0 top
R11332  10K  [0201]  93.62,81.13 0 top
R11333  10K  [0201]  93.62,81.74 0 top
R11334  10K  [0201]  93.62,82.35 0 top
R11335  10K  [0201]  93.62,82.96 0 top
R11336  10K  [0201]  93.62,83.57 0 top
R11337  10K  [0201]  93.62,84.18 0 top
R11338  10K  [0201]  93.62,84.79 0 top
R11339  10K  [0201]  93.62,85.39 0 top
R11340  10K  [0201]  93.62,86 0 top
R11341  10K  [0201]  93.62,86.61 0 top
R11342  10K  [0201]  93.62,87.22 0 top
R11343  10K  [0201]  93.62,87.83 0 top
R11344  10K  [0201]  93.62,88.44 0 top
R11345  10K  [0201]  93.62,89.05 0 top
R11346  10K  [0201]  93.62,89.66 0 top
R11347  10K  [0201]  93.62,90.27 0 top
R11348  10K  [0201]  93.62,90.88 0 top
R11349  10K  [0201]  93.62,91.49 0 top
R11350  10K  [0201]  93.62,92.1 0 top
R11351  10K  [0201]  93.62,92.71 0 top
R11352  10K  [0201]  93.62,93.32 0 top
R11353  10K  [0201]  93.62,93.93 0 top
R11354  10K  [0201]  93.62,94.54 0 top
R11355  10K  [0201]  93.62,95.15 0 top
R11356  10K  [0201]  93.62,95.76 0 top
R11357  10K  [0201]  93.62,96.37 0 top
R11358  10K  [0201]  93.62,96.98 0 top
R11359  10K  [0201]  93.62,97.59 0 top
R11360  10K  [0201]  93.62,98.2 0 top
R11361  10K  [0201]  93.62,98.81 0 top
R11362  10K  [0201]  93.62,99.42 0 top
R11363  10K  [0201]  93.62,100.03 0 top
R11364  10K  [0201]  93.62,100.63 0 top
R11365  10K  [0201]  93.62,101.24 0 top
R11366  10K  [0201]  93.62,101.85 0 top
R11367  10K  [0201]  93.62,102.46 0 top
R11368  10K  [0201]  93.62,103.07 0 top
R11369  10K  [0201]  93.62,103.68 0 top
R11370  10K  [0201]  93.62,104.29 0 top
R11371  10K  [0201]  93.62,104.9 0 top
R11372  10K  [0201]  93.62,105.51 0 top
R11373  10K  [0201]  93.62,106.12 0 top
R11374  10K  [0201]  93.62,106.73 0 top
R11375  10K  [0201]  93.62,107.34 0 top
R11376  10K  [0201]  93.62,107.95 0 top
R11377  10K  [0201]  93.62,108.56 0 top
R11378  10K  [0201]  93.62,109.17 0 top
R11379  10K  [0201]  93.62,109.78 0 top
R11380  10K  [0201]  93.62,110.39 0 top
R11381  10K  [0201]  93.62,111 0 top
R11382  10K  [0201]  93.62,111.61 0 top
R11383  10K  [0201]  93.62,112.22 0 top
R11384  10K  [0201]  93.62,112.83 0 top
R11385  10K  [0201]  93.62,113.44 0 top
R11386  10K  [0201]  93.62,114.05 0 top
R11387  10K  [0201]  93.62,114.66 0 top
R11388  10K  [0201]  93.62,115.27 0 top
R11389  10K  [0201]  93.62,115.87 0 top
R11390  10K  [0201]  93.62,116.48 0 top
R11391  10K  [0201]  93.62,117.09 0 top
R11392  10K  [0201]  93.62,117.7 0 top
R11393  10K  [0201]  93.62,118.31 0 top
R11394  10K  [0201]  93.62,118.92 0 top
R11395  10K  [0201]  93.62,119.53 0 top
R11396  10K  [0201]  93.62,120.14 0 top
R11397  10K  [0201]  93.62,120.75 0 top
R11398  10K  [0201]  93.62,121.36 0 top
R11399  10K  [0201]  93.62,121.97 0 top
R11400  10K  [0201]  93.62,122.58 0 top
R11401  10K  [0201]  94.84,1.27 0 top
R11402  10K  [0201]  94.84,1.88 0 top
R11403  10K  [0201]  94.84,2.49 0 top
R11404  10K  [0201]  94.84,3.1 0 top
R11405  10K  [0201]  94.84,3.71 0 top
R11406  10K  [0201]  94.84,4.32 0 top
R11407  10K  [0201]  94.84,4.93 0 top
R11408  10K  [0201]  94.84,5.54 0 top
R11409  10K  [0201]  94.84,6.15 0 top
R11410  10K  [0201]  94.84,6.76 0 top
R11411  10K  [0201]  94.84,7.37 0 top
R11412  10K  [0201]  94.84,7.98 0 top
R11413  10K  [0201]  94.84,8.59 0 top
R11414  10K  [0201]  94.84,9.19 0 top
R11415  10K  [0201]  94.84,9.8 0 top
R11416  10K  [0201]  94.84,10.41 0 top
R11417  10K  [0201]  94.84,11.02 0 top
R11418  10K  [0201]  94.84,11.63 0 top
R11419  10K  [0201]  94.84,12.24 0 top
R11420  10K  [0201]  94.84,12.85 0 top
R11421  10K  [0201]  94.84,13.46 0 top
R11422  10K  [0201]  94.84,14.07 0 top
R11423  10K  [0201]  94.84,14.68 0 top
R11424  10K  [0201]  94.84,15.29 0 top
R11425  10K  [0201]  94.84,15.9 0 top
R11426  10K  [0201]  94.84,16.51 0 top
R11427  10K  [0201]  94.84,17.12 0 top
R11428  10K  [0201]  94.84,17.73 0 top
R11429  10K  [0201]  94.84,18.34 0 top
R11430  10K  [0201]  94.84,18.95 0 top
R11431  10K  [0201]  94.84,19.56 0 top
R11432  10K  [0201]  94.84,20.17 0 top
R11433  10K  [0201]  94.84,20.78 0 top
R11434  10K  [0201]  94.84,21.39 0 top
R11435  10K  [0201]  94.84,22 0 top
R11436  10K  [0201]  94.84,22.61 0 top
R11437  10K  [0201]  94.84,23.22 0 top
R11438  10K  [0201]  94.84,23.83 0 top
R11439  10K  [0201]  94.84,24.43 0 top
R11440  10K  [0201]  94.84,25.04 0 top
R11441  10K  [0201]  94.84,25.65 0 top
R11442  10K  [0201]  94.84,26.26 0 top
R11443  10K  [0201]  94.84,26.87 0 top
R11444  10K  [0201]  94.84,27.48 0 top
R11445  10K  [0201]  94.84,28.09 0 top
R11446  10K  [0201]  94.84,28.7 0 top
R11447  10K  [0201]  94.84,29.31 0 top
R11448  10K  [0201]  94.84,29.92 0 top
R11449  10K  [0201]  94.84,30.53 0 top
R11450  10K  [0201]  94.84,31.14 0 top
R11451  10K  [0201]  94.84,31.75 0 top
R11452  10K  [0201]  94.84,32.36 0 top
R11453  10K  [0201]  94.84,32.97 0 top
R11454  10K  [0201]  94.84,33.58 0 top
R11455  10K  [0201]  94.84,34.19 0 top
R11456  10K  [0201]  94.84,34.8 0 top
R11457  10K  [0201]  94.84,35.41 0 top
R11458  10K  [0201]  94.84,36.02 0 top
R11459  10K  [0201]  94.84,36.63 0 top
R11460  10K  [0201]  94.84,37.24 0 top
R11461  10K  [0201]  94.84,37.85 0 top
R11462  10K  [0201]  94.84,38.46 0 top
R11463  10K  [0201]  94.84,39.07 0 top
R11464  10K  [0201]  94.84,39.67 0 top
R11465  10K  [0201]  94.84,40.28 0 top
R11466  10K  [0201]  94.84,40.89 0 top
R11467  10K  [0201]  94.84,41.5 0 top
R11468  10K  [0201]  94.84,42.11 0 top
R11469  10K  [0201]  94.84,42.72 0 top
R11470  10K  [0201]  94.84,43.33 0 top
R11471  10K  [0201]  94.84,43.94 0 top
R11472  10K  [0201]  94.84,44.55 0 top
R11473  10K  [0201]  94.84,45.16 0 top
R11474  10K  [0201]  94.84,45.77 0 top
R11475  10K  [0201]  94.84,46.38 0 top
R11476  10K  [0201]  94.84,46.99 0 top
R11477  10K  [0201]  94.84,47.6 0 top
R11478  10K  [0201]  94.84,48.21 0 top
R11479  10K  [0201]  94.84,48.82 0 top
R11480  10K  [0201]  94.84,49.43 0 top
R11481  10K  [0201]  94.84,50.04 0 top
R11482  10K  [0201]  94.84,50.65 0 top
R11483  10K  [0201]  94.84,51.26 0 top
R11484  10K  [0201]  94.84,51.87 0 top
R11485  10K  [0201]  94.84,52.48 0 top
R11486  10K  [0201]  94.84,53.09 0 top
R11487  10K  [0201]  94.84,53.7 0 top
R11488  10K  [0201]  94.84,54.31 0 top
R11489  10K  [0201]  94.84,54.91 0 top
R11490  10K  [0201]  94.84,55.52 0 top
R11491  10K  [0201]  94.84,56.13 0 top
R11492  10K  [0201]  94.84,56.74 0 top
R11493  10K  [0201]  94.84,57.35 0 top
R11494  10K  [0201]  94.84,57.96 0 top
R11495  10K  [0201]  94.84,58.57 0 top
R11496  10K  [0201]  94.84,59.18 0 top
R11497  10K  [0201]  94.84,59.79 0 top
R11498  10K  [0201]  94.84,60.4 0 top
R11499  10K  [0201]  94.84,61.01 0 top
R11500  10K  [0201]  94.84,61.62 0 top
R11501  10K  [0201]  94.84,62.23 0 top
R11502  10K  [0201]  94.84,62.84 0 top
R11503  10K  [0201]  94.84,63.45 0 top
R11504  10K  [0201]  94.84,64.06 0 top
R11505  10K  [0201]  94.84,64.67 0 top
R11506  10K  [0201]  94.84,65.28 0 top
R11507  10K  [0201]  94.84,65.89 0 top
R11508  10K  [0201]  94.84,66.5 0 top
R11509  10K  [0201]  94.84,67.11 0 top
R11510  10K  [0201]  94.84,67.72 0 top
R11511  10K  [0201]  94.84,68.33 0 top
R11512  10K  [0201]  94.84,68.94 0 top
R11513  10K  [0201]  94.84,69.55 0 top
R11514  10K  [0201]  94.84,70.15 0 top
R11515  10K  [0201]  94.84,70.76 0 top
R11516  10K  [0201]  94.84,71.37 0 top
R11517  10K  [0201]  94.84,71.98 0 top
R11518  10K  [0201]  94.84,72.59 0 top
R11519  10K  [0201]  94.84,73.2 0 top
R11520  10K  [0201]  94.84,73.81 0 top
R11521  10K  [0201]  94.84,74.42 0 top
R11522  10K  [0201]  94.84,75.03 0 top
R11523  10K  [0201]  94.84,75.64 0 top
R11524  10K  [0201]  94.84,76.25 0 top
R11525  10K  [0201]  94.84,76.86 0 top
R11526  10K  [0201]  94.84,77.47 0 top
R11527  10K  [0201]  94.84,78.08 0 top
R11528  10K  [0201]  94.84,78.69 0 top
R11529  10K  [0201]  94.84,79.3 0 top
R11530  10K  [0201]  94.84,79.91 0 top
R11531  10K  [0201]  94.84,80.52 0 top
R11532  10K  [0201]  94.84,81.13 0 top
R11533  10K  [0201]  94.84,81.74 0 top
R11534  10K  [0201]  94.84,82.35 0 top
R11535  10K  [0201]  94.84,82.96 0 top
R11536  10K  [0201]  94.84,83.57 0 top
R11537  10K  [0201]  94.84,84.18 0 top
R11538  10K  [0201]  94.84,84.79 0 top
R11539  10K  [0201]  94.84,85.39 0 top
R11540  10K  [0201]  94.84,86 0 top
R11541  10K  [0201]  94.84,86.61 0 top
R11542  10K  [0201]  94.84,87.22 0 top
R11543  10K  [0201]  94.84,87.83 0 top
R11544  10K  [0201]  94.84,88.44 0 top
R11545  10K  [0201]  94.84,89.05 0 top
R11546  10K  [0201]  94.84,89.66 0 top
R11547  10K  [0201]  94.84,90.27 0 top
R11548  10K  [0201]  94.84,90.88 0 top
R11549  10K  [0201]  94.84,91.49 0 top
R11550  10K  [0201]  94.84,92.1 0 top
R11551  10K  [0201]  94.84,92.71 0 top
R11552  10K  [0201]  94.84,93.32 0 top
R11553  10K  [0201]  94.84,93.93 0 top
R11554  10K  [0201]  94.84,94.54 0 top
R11555  10K  [0201]  94.84,95.15 0 top
R11556  10K  [0201]  94.84,95.76 0 top
R11557  10K  [0201]  94.84,96.37 0 top
R11558  10K  [0201]  94.84,96.98 0 top
R11559  10K  [0201]  94.84,97.59 0 top
R11560  10K  [0201]  94.84,98.2 0 top
R11561  10K  [0201]  94.84,98.81 0 top
R11562  10K  [0201]  94.84,99.42 0 top
R11563  10K  [0201]  94.84,100.03 0 top
R11564  10K  [0201]  94.84,100.63 0 top
R11565  10K  [0201]  94.84,101.24 0 top
R11566  10K  [0201]  94.84,101.85 0 top
R11567  10K  [0201]  94.84,102.46 0 top
R11568  10K  [0201]  94.84,103.07 0 top
R11569  10K  [0201]  94.84,103.68 0 top
R11570  10K  [0201]  94.84,104.29 0 top
R11571  10K  [0201]  94.84,104.9 0 top
R11572  10K  [0201]  94.84,105.51 0 top
R11573  10K  [0201]  94.84,106.12 0 top
R11574  10K  [0201]  94.84,106.73 0 top
R11575  10K  [0201]  94.84,107.34 0 top
R11576  10K  [0201]  94.84,107.95 0 top
R11577  10K  [0201]  94.84,108.56 0 top
R11578  10K  [0201]  94.84,109.17 0 top
R11579  10K  [0201]  94.84,109.78 0 top
R11580  10K  [0201]  94.84,110.39 0 top
R11581  10K  [0201]  94.84,111 0 top
R11582  10K  [0201]  94.84,111.61 0 top
R11583  10K  [0201]  94.84,112.22 0 top
R11584  10K  [0201]  94.84,112.83 0 top
R11585  10K  [0201]  94.84,113.44 0 top
R11586  10K  [0201]  94.84,114.05 0 top
R11587  10K  [0201]  94.84,114.66 0 top
R11588  10K  [0201]  94.84,115.27 0 top
R11589  10K  [0201]  94.84,115.87 0 top
R11590  10K  [0201]  94.84,116.48 0 top
R11591  10K  [0201]  94.84,117.09 0 top
R11592  10K  [0201]  94.84,117.7 0 top
R11593  10K  [0201]  94.84,118.31 0 top
R11594  10K  [0201]  94.84,118.92 0 top
R11595  10K  [0201]  94.84,119.53 0 top
R11596  10K  [0201]  94.84,120.14 0 top
R11597  10K  [0201]  94.84,120.75 0 top
R11598  10K  [0201]  94.84,121.36 0 top
R11599  10K  [0201]  94.84,121.97 0 top
R11600  10K  [0201]  94.84,122.58 0 top
R11601  10K  [0201]  96.06,1.27 0 top
R11602  10K  [0201]  96.06,1.88 0 top
R11603  10K  [0201]  96.06,2.49 0 top
R11604  10K  [0201]  96.06,3.1 0 top
R11605  10K  [0201]  96.06,3.71 0 top
R11606  10K  [0201]  96.06,4.32 0 top
R11607  10K  [0201]  96.06,4.93 0 top
R11608  10K  [0201]  96.06,5.54 0 top
R11609  10K  [0201]  96.06,6.15 0 top
R11610  10K  [0201]  96.06,6.76 0 top
R11611  10K  [0201]  96.06,7.37 0 top
R11612  10K  [0201]  96.06,7.98 0 top
R11613  10K  [0201]  96.06,8.59 0 top
R11614  10K  [0201]  96.06,9.19 0 top
R11615  10K  [0201]  96.06,9.8 0 top
R11616  10K  [0201]  96.06,10.41 0 top
R11617  10K  [0201]  96.06,11.02 0 top
R11618  10K  [0201]  96.06,11.63 0 top
R11619  10K  [0201]  96.06,12.24 0 top
R11620  10K  [0201]  96.06,12.85 0 top
R11621  10K  [0201]  96.06,13.46 0 top
R11622  10K  [0201]  96.06,14.07 0 top
R11623  10K  [0201]  96.06,14.68 0 top
R11624  10K  [0201]  96.06,15.29 0 top
R11625  10K  [0201]  96.06,15.9 0 top
R11626  10K  [0201]  96.06,16.51 0 top
R11627  10K  [0201]  96.06,17.12 0 top
R11628  10K  [0201]  96.06,17.73 0 top
R11629  10K  [0201]  96.06,18.34 0 top
R11630  10K  [0201]  96.06,18.95 0 top
R11631  10K  [0201]  96.06,19.56 0 top
R11632  10K  [0201]  96.06,20.17 0 top
R11633  10K  [0201]  96.06,20.78 0 top
R11634  10K  [0201]  96.06,21.39 0 top
R11635  10K  [0201]  96.06,22 0 top
R11636  10K  [0201]  96.06,22.61 0 top
R11637  10K  [0201]  96.06,23.22 0 top
R11638  10K  [0201]  96.06,23.83 0 top
R11639  10K  [0201]  96.06,24.43 0 top
R11640  10K  [0201]  96.06,25.04 0 top
R11641  10K  [0201]  96.06,25.65 0 top
R11642  10K  [0201]  96.06,26.26 0 top
R11643  10K  [0201]  96.06,26.87 0 top
R11644  10K  [0201]  96.06,27.48 0 top
R11645  10K  [0201]  96.06,28.09 0 top
R11646  10K  [0201]  96.06,28.7 0 top
R11647  10K  [0201]  96.06,29.31 0 top
R11648  10K  [0201]  96.06,29.92 0 top
R11649  10K  [0201]  96.06,30.53 0 top
R11650  10K  [0201]  96.06,31.14 0 top
R11651  10K  [0201]  96.06,31.75 0 top
R11652  10K  [0201]  96.06,32.36 0 top
R11653  10K  [0201]  96.06,32.97 0 top
R11654  10K  [0201]  96.06,33.58 0 top
R11655  10K  [0201]  96.06,34.19 0 top
R11656  10K  [0201]  96.06,34.8 0 top
R11657  10K  [0201]  96.06,35.41 0 top
R11658  10K  [0201]  96.06,36.02 0 top
R11659  10K  [0201]  96.06,36.63 0 top
R11660  10K  [0201]  96.06,37.24 0 top
R11661  10K  [0201]  96.06,37.85 0 top
R11662  10K  [0201]  96.06,38.46 0 top
R11663  10K  [0201]  96.06,39.07 0 top
R11664  10K  [0201]  96.06,39.67 0 top
R11665  10K  [0201]  96.06,40.28 0 top
R11666  10K  [0201]  96.06,40.89 0 top
R11667  10K  [0201]  96.06,41.5 0 top
R11668  10K  [0201]  96.06,42.11 0 top
R11669  10K  [0201]  96.06,42.72 0 top
R11670  10K  [0201]  96.06,43.33 0 top
R11671  10K  [0201]  96.06,43.94 0 top
R11672  10K  [0201]  96.06,44.55 0 top
R11673  10K  [0201]  96.06,45.16 0 top
R11674  10K  [0201]  96.06,45.77 0 top
R11675  10K  [0201]  96.06,46.38 0 top
R11676  10K  [0201]  96.06,46.99 0 top
R11677  10K  [0201]  96.06,47.6 0 top
R11678  10K  [0201]  96.06,48.21 0 top
R11679  10K  [0201]  96.06,48.82 0 top
R11680  10K  [0201]  96.06,49.43 0 top
R11681  10K  [0201]  96.06,50.04 0 top
R11682  10K  [0201]  96.06,50.65 0 top
R11683  10K  [0201]  96.06,51.26 0 top
R11684  10K  [0201]  96.06,51.87 0 top
R11685  10K  [0201]  96.06,52.48 0 top
R11686  10K  [0201]  96.06,53.09 0 top
R11687  10K  [0201]  96.06,53.7 0 top
R11688  10K  [0201]  96.06,54.31 0 top
R11689  10K  [0201]  96.06,54.91 0 top
R11690  10K  [0201]  96.06,55.52 0 top
R11691  10K  [0201]  96.06,56.13 0 top
R11692  10K  [0201]  96.06,56.74 0 top
R11693  10K  [0201]  96.06,57.35 0 top
R11694  10K  [0201]  96.06,57.96 0 top
R11695  10K  [0201]  96.06,58.57 0 top
R11696  10K  [0201]  96.06,59.18 0 top
R11697  10K  [0201]  96.06,59.79 0 top
R11698  10K  [0201]  96.06,60.4 0 top
R11699  10K  [0201]  96.06,61.01 0 top
R11700  10K  [0201]  96.06,61.62 0 top
R11701  10K  [0201]  96.06,62.23 0 top
R11702  10K  [0201]  96.06,62.84 0 top
R11703  10K  [0201]  96.06,63.45 0 top
R11704  10K  [0201]  96.06,64.06 0 top
R11705  10K  [0201]  96.06,64.67 0 top
R11706  10K  [0201]  96.06,65.28 0 top
R11707  10K  [0201]  96.06,65.89 0 top
R11708  10K  [0201]  96.06,66.5 0 top
R11709  10K  [0201]  96.06,67.11 0 top
R11710  10K  [0201]  96.06,67.72 0 top
R11711  10K  [0201]  96.06,68.33 0 top
R11712  10K  [0201]  96.06,68.94 0 top
R11713  10K  [0201]  96.06,69.55 0 top
R11714  10K  [0201]  96.06,70.15 0 top
R11715  10K  [0201]  96.06,70.76 0 top
R11716  10K  [0201]  96.06,71.37 0 top
R11717  10K  [0201]  96.06,71.98 0 top
R11718  10K  [0201]  96.06,72.59 0 top
R11719  10K  [0201]  96.06,73.2 0 top
R11720  10K  [0201]  96.06,73.81 0 top
R11721  10K  [0201]  96.06,74.42 0 top
R11722  10K  [0201]  96.06,75.03 0 top
R11723  10K  [0201]  96.06,75.64 0 top
R11724  10K  [0201]  96.06,76.25 0 top
R11725  10K  [0201]  96.06,76.86 0 top
R11726  10K  [0201]  96.06,77.47 0 top
R11727  10K  [0201]  96.06,78.08 0 top
R11728  10K  [0201]  96.06,78.69 0 top
R11729  10K  [0201]  96.06,79.3 0 top
R11730  10K  [0201]  96.06,79.91 0 top
R11731  10K  [0201]  96.06,80.52 0 top
R11732  10K  [0201]  96.06,81.13 0 top
R11733  10K  [0201]  96.06,81.74 0 top
R11734  10K  [0201]  96.06,82.35 0 top
R11735  10K  [0201]  96.06,82.96 0 top
R11736  10K  [0201]  96.06,83.57 0 top
R11737  10K  [0201]  96.06,84.18 0 top
R11738  10K  [0201]  96.06,84.79 0 top
R11739  10K  [0201]  96.06,85.39 0 top
R11740  10K  [0201]  96.06,86 0 top
R11741  10K  [0201]  96.06,86.61 0 top
R11742  10K  [0201]  96.06,87.22 0 top
R11743  10K  [0201]  96.06,87.83 0 top
R11744  10K  [0201]  96.06,88.44 0 top
R11745  10K  [0201]  96.06,89.05 0 top
R11746  10K  [0201]  96.06,89.66 0 top